# EasyEDA Pro project Chessboards.epro, board Diagonal (continued)
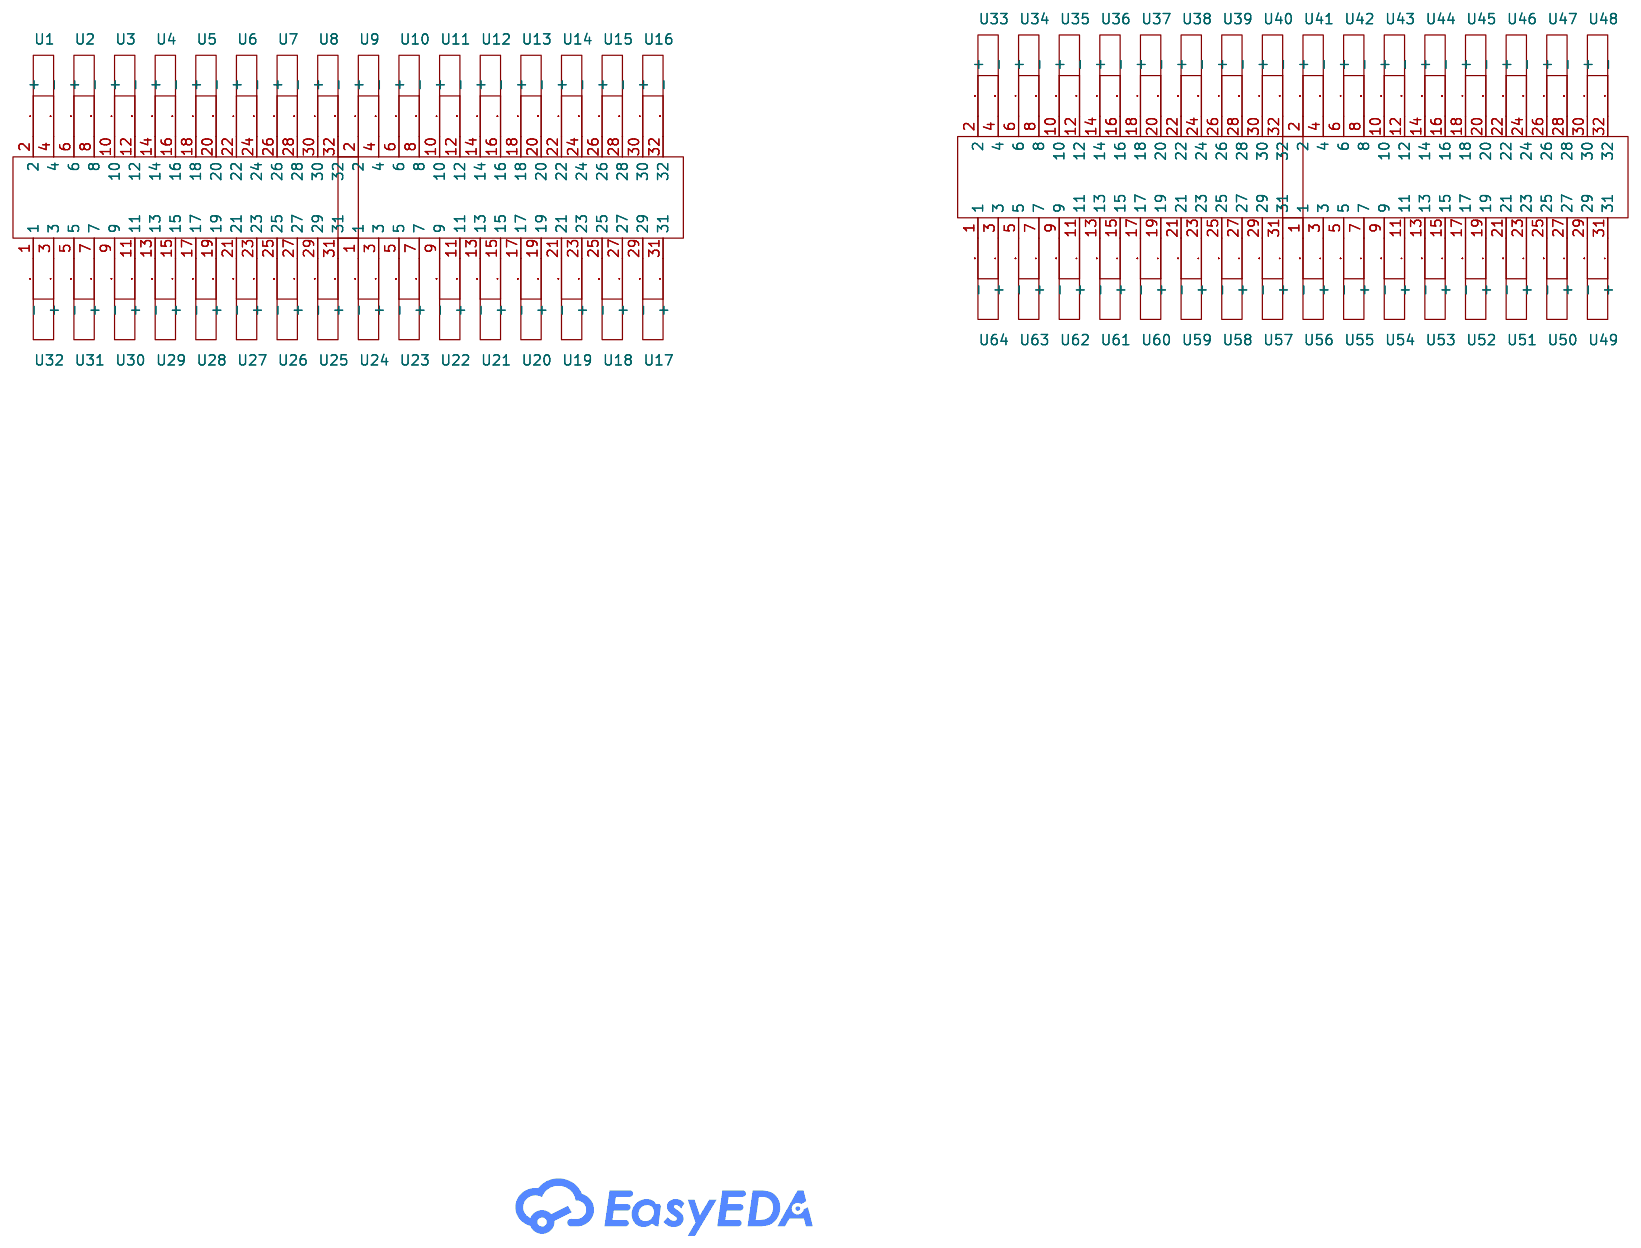
[diagram p0: schematic sheet]
## Routing (per net, layer and track width the routed paths; a pad name or vN(x,y) marks a point on that pad's centre or on a via; arc(x,y) is an arc through that point) (continued)
  Bottom Layer w0.254: 333.72,470.74 333.72,472.96 ; 333.72,470.74 333.72,470.71 334.58,469.85 ; 333.72,470.74 v2(334.58,469.87) ; 333.72,472.96 333.72,472.98 333.72,472.99 ; 333.72,472.96 333.72,472.96 ; 314.66,473.08 314.65,473.07 314.65,473.05 ; 327.28,478.03 327.28,478.06 327.6,478.37 ; 327.28,478.03 327.6,478.35 ; 327.28,478.03 327.28,476.69 ; 457.89,7.01 457.89,7.01 457.89,9.67 v2(458.4,10.18) ; v2(208.5,3.71) 208.5,1.43 ; 308.28,473.05 308.28,473.07 308.29,473.08 ; 308.28,473.05 308.29,473.05 ; 308.28,473.05 308.28,470.41 ; 158.22,472.96 158.22,472.96 158.22,470.72 v2(159.08,469.85) ; v2(94.92,476.35) 94.61,476.66 94.61,478.03 94.92,478.35 ; v2(392.1,476.35) 392.1,478.64 ; v2(391.33,10.22) 390.47,9.35 390.47,7.11 390.47,7.11 ; 230.25,7.11 230.25,7.11 230.25,9.35 v2(231.11,10.22) ; 255.16,478.35 254.84,478.03 254.84,476.66 v2(255.16,476.35) ; v2(226.78,476.35) 226.78,478.64 ; v2(74.19,476.35) 74.19,478.64 ; 412.2,469.89 411.29,470.81 411.29,472.96 ; 307.01,470.41 307.01,473.05 ; 307.01,470.41 307.01,470.39 307.52,469.88 ; 307.01,470.41 v2(307.52,469.9) ; 307.01,473.05 307.01,473.05 ; 307.01,473.05 307.01,473.07 307.01,473.08 ; 317.15,472.96 317.16,472.96 ; 317.15,472.96 317.15,472.98 317.16,472.99 ; 317.15,472.96 317.15,470.74 ; v2(223.16,10.19) 222.65,9.68 222.65,7.02 222.66,7.01 ; 165.87,472.99 165.82,472.99 165.77,472.93 165.77,470.81 166.7,469.87 ; 136.17,7.01 136.16,7.01 136.16,9.67 v2(136.68,10.18) ; 320.98,472.99 320.98,472.98 320.98,472.96 ; v2(394.02,469.88) 393.51,470.39 393.51,473.05 393.51,473.05 ; v2(391.47,469.88) 390.96,470.39 390.96,473.05 390.96,473.05 ; 301.78,476.35 301.78,478.66 ; v2(86.61,469.85) 85.63,470.84 85.63,472.96 85.63,472.96 85.75,472.96 ; v2(315.69,3.69) 315.38,3.38 315.38,2.01 315.69,1.69 ; v2(81.52,469.85) 80.65,470.71 80.65,472.96 80.66,472.96 ; 235.35,7.11 235.22,7.11 235.22,7.11 235.22,9.23 v2(236.21,10.22) ; v2(81.74,3.72) 81.42,3.4 81.42,2.03 81.74,1.72 ; 410,478.07 410,476.71 410.32,476.39 ; 410,478.07 409.96,478.03 409.96,476.66 v2(410.28,476.35) ; 410,478.07 410.28,478.35 ; 410,478.07 410,478.08 410.32,478.39 ; 334.89,472.96 334.89,472.98 334.89,472.99 334.99,472.99 ; 334.89,472.96 334.89,472.96 334.99,472.96 ; 334.89,472.96 334.89,470.84 ; v2(388.27,476.35) 388.27,478.64 ; 65.42,473.05 65.41,473.05 65.41,470.39 v2(65.93,469.88) ; 93.4,472.96 93.39,472.96 93.39,470.71 v2(94.26,469.85) ; 453.79,469.92 453.28,470.43 453.28,473.09 453.28,473.09 ; v2(400.09,476.35) 399.77,476.66 399.77,478.03 399.81,478.07 ; 407.46,478.07 407.41,478.03 407.41,476.66 v2(407.73,476.35) ; 407.46,478.07 407.46,478.08 407.77,478.39 ; 407.46,478.07 407.73,478.35 ; 407.46,478.07 407.46,476.71 407.77,476.39 ; 174.76,472.96 174.79,472.96 ; 174.76,472.96 174.74,472.96 ; 174.76,472.96 174.73,472.94 174.73,470.77 v2(175.65,469.85) ; v2(220.62,10.19) 220.11,9.68 220.11,7.02 220.11,7.01 ; 397.26,478.07 397.26,476.71 397.58,476.39 ; 397.26,478.07 397.54,478.35 ; 397.26,478.07 397.26,478.08 397.58,478.39 ; 397.26,478.07 397.22,478.03 397.22,476.66 v2(397.54,476.35) ; v2(240.7,3.72) 240.38,3.4 240.38,2.03 240.7,1.72 ; v2(231.78,3.72) 231.46,3.4 231.46,2.03 231.78,1.72 ; 402.68,478.39 402.36,478.08 402.36,478.07 ; 406.5,476.39 406.18,476.71 406.18,478.07 ; 248.78,478.35 248.47,478.03 248.47,476.66 v2(248.78,476.35) ; 145.53,473.05 145.53,473.05 145.53,470.39 v2(146.04,469.88) ; 408.73,478.07 408.73,476.71 409.05,476.39 ; 408.73,478.07 408.69,478.03 408.69,476.66 v2(409,476.35) ; 408.73,478.07 409,478.35 ; 408.73,478.07 408.73,478.08 409.05,478.39 ; v2(238.15,3.72) 237.83,3.4 237.83,2.03 238.15,1.72 ; v2(130.93,3.71) 130.93,1.42 ; 296.68,476.35 296.68,478.66 ; 412.62,473 412.61,473 412.61,470.76 413.48,469.89 ; v2(296.05,469.9) 295.54,470.41 ; 295.54,470.41 295.54,473.05 ; 295.54,470.41 295.54,470.39 296.05,469.88 ; v2(240.03,10.22) 239.17,9.35 239.17,7.11 239.17,7.11 ; 308.05,1.69 307.73,2.01 307.73,3.38 v2(308.05,3.69) ; v2(402.19,3.72) 401.87,3.4 401.87,2.03 402.19,1.72 ; v2(294.34,10.16) 293.83,9.65 293.83,6.99 293.83,6.99 ; v2(168.83,10.21) 167.97,9.35 167.97,7.1 167.97,7.1 ; 398.19,469.89 397.33,470.76 397.33,473 397.33,473 ; 323.45,470.81 323.45,470.79 324.39,469.85 ; 323.45,470.81 v2(324.39,469.87) ; 323.45,470.81 323.45,472.91 ; v2(82.79,469.85) 81.93,470.71 81.93,472.96 81.93,472.96 ; v2(405.35,10.22) 404.48,9.35 404.48,7.11 404.49,7.11 ; 408.38,469.89 407.52,470.76 407.52,473 407.52,473 ; v2(169.94,476.35) 169.62,476.67 169.62,478.03 169.94,478.35 ; 292.55,6.99 292.55,6.99 292.55,9.65 v2(293.06,10.16) ; 311.62,7.08 311.61,7.08 311.61,9.33 v2(312.48,10.19) ; 395.99,478.07 396.26,478.35 ; 395.99,478.07 395.99,478.08 396.31,478.39 ; 395.99,478.07 395.99,476.71 396.31,476.39 ; 395.99,478.07 395.95,478.03 395.95,476.66 v2(396.26,476.35) ; v2(247.51,476.35) 247.19,476.66 247.19,478.03 247.51,478.35 ; v2(163.74,10.21) 162.87,9.35 162.87,7.1 162.88,7.1 ; 142.98,473.05 142.98,473.05 142.98,470.39 v2(143.49,469.88) ; 394.72,478.07 394.99,478.35 ; 394.72,478.07 394.67,478.03 394.67,476.66 v2(394.99,476.35) ; 394.72,478.07 394.72,478.08 395.03,478.39 ; 394.72,478.07 394.72,476.71 395.03,476.39 ; 412.55,478.07 412.55,476.71 412.87,476.39 ; 412.55,478.07 412.51,478.03 412.51,476.66 v2(412.83,476.35) ; 412.55,478.07 412.83,478.35 ; 412.55,478.07 412.55,478.08 412.87,478.39 ; v2(382.11,10.19) 381.6,9.68 381.6,7.02 381.6,7.01 ; 87.28,478.35 86.96,478.03 86.96,476.66 v2(87.28,476.35) ; 167.14,472.96 167.14,472.96 167.14,470.72 v2(168,469.85) ; 177.33,472.99 177.21,472.99 177.21,472.98 177.21,470.84 178.17,469.87 ; v2(467.11,476.36) 467.11,478.64 ; 166.1,476.37 165.78,476.69 165.78,478.06 166.1,478.37 ; v2(388.18,3.72) 387.86,3.4 387.86,2.03 388.18,1.72 ; v2(151,10.21) 150.13,9.35 150.13,7.1 150.14,7.1 ; v2(153.54,10.21) 152.68,9.35 152.68,7.1 152.68,7.1 ; 411.29,472.96 411.28,472.96 411.25,472.93 411.25,470.76 v2(412.16,469.85) ; 411.29,472.96 411.29,472.98 411.32,473 411.34,473 ; 411.29,472.96 411.3,472.96 ; 317.41,476.35 317.09,476.66 317.09,476.69 ; 315.82,478.03 316.13,478.35 ; 315.82,478.03 315.82,476.69 ; 315.82,478.03 315.82,478.06 316.13,478.37 ; 297.33,469.88 296.82,470.39 296.82,470.41 ; 326.33,478.37 326.01,478.06 326.01,478.03 ; 374.95,469.92 374.44,470.43 374.44,473.09 374.44,473.1 ; v2(291.14,3.69) 291.14,1.4 ; v2(216.59,476.35) 216.59,478.64 ; 161,478.37 160.68,478.06 160.68,476.69 161,476.37 ; 318.37,476.69 318.37,476.66 318.68,476.35 ; 318.37,476.69 318.37,478.03 ; 318.37,476.69 v2(318.68,476.37) ; 310.83,473.05 310.83,473.07 310.83,473.08 ; 310.83,473.05 310.83,470.41 ; 310.83,473.05 310.83,473.05 ; v2(155.48,3.71) 155.17,3.4 155.17,2.03 155.48,1.71 ; 322.19,478.03 322.19,478.06 322.5,478.37 ; 322.19,478.03 322.5,478.35 ; 322.19,478.03 322.19,476.69 ; v2(72.3,469.88) 71.78,470.39 71.78,473.05 71.79,473.05 ; 380.81,473.1 380.81,473.09 380.81,470.43 381.32,469.92 ; v2(448.83,3.71) 448.83,1.42 ; v2(383.38,10.19) 382.87,9.68 382.87,7.02 382.88,7.01 ; 383.87,469.92 383.36,470.43 383.36,473.09 383.36,473.1 ; v2(255.76,469.85) 254.9,470.71 254.9,472.96 254.9,472.96 ; 157.78,7.1 157.75,7.1 157.7,7.15 157.7,9.27 v2(158.64,10.21) ; 380.77,473.05 380.77,473.05 380.77,470.39 v2(381.28,469.88) ; 159.05,7.1 159.05,7.1 159.05,9.35 v2(159.91,10.21) ; 142.54,7.01 142.53,7.01 142.53,9.67 v2(143.05,10.18) ; 252.61,478.35 252.29,478.03 252.29,476.66 v2(252.61,476.35) ; v2(73.43,10.22) 72.57,9.35 72.57,7.11 72.57,7.11 ; v2(300.71,10.16) 300.19,9.65 300.19,6.99 300.2,6.99 ; v2(242.42,476.35) 242.1,476.66 242.1,478.03 242.42,478.35 ; v2(244.3,469.85) 243.31,470.84 243.31,472.96 243.31,472.96 243.44,472.96 ; v2(305.8,10.16) 305.29,9.65 305.29,6.99 305.29,6.99 ; v2(62.73,476.35) 62.73,478.64 ; v2(86.84,3.72) 86.52,3.4 86.52,2.03 86.84,1.72 ; 385.42,7.01 385.42,7.02 385.42,9.68 v2(385.93,10.19) ; 82.76,7.11 82.76,7.11 82.76,9.35 v2(83.62,10.22) ; 404.91,478.07 405.18,478.35 ; 404.91,478.07 404.87,478.03 404.87,476.66 v2(405.18,476.35) ; 404.91,478.07 404.91,476.71 405.22,476.39 ; 404.91,478.07 404.91,478.08 405.22,478.39 ; 401.02,472.96 401.02,470.88 402.01,469.89 ; 401.02,472.96 400.98,472.96 400.98,472.96 400.98,470.84 v2(401.97,469.85) ; 401.02,472.96 401.02,473 401.03,473 401.15,473 ; 401.02,472.96 401.11,472.96 ; v2(77.25,10.22) 76.39,9.35 76.39,7.11 76.39,7.11 ; 331.42,476.35 331.11,476.66 331.11,476.69 ; 318.37,478.03 318.68,478.35 ; 318.37,478.03 318.37,478.06 318.68,478.37 ; v2(308.79,469.9) 308.28,470.41 ; 308.28,470.41 308.28,470.39 308.79,469.88 ; 313.38,473.08 313.38,473.07 313.38,473.05 ; 458.24,476.39 458.24,478.68 ; 165.84,472.96 165.79,472.91 165.79,470.79 v2(166.73,469.85) ; v2(161.02,476.35) 160.71,476.67 160.71,478.03 161.02,478.35 ; v2(223.61,469.88) 223.1,470.39 223.1,473.05 223.1,473.05 ; v2(313.89,469.9) 313.38,470.41 ; 313.38,470.41 313.38,470.39 313.89,469.88 ; 313.38,470.41 313.38,473.05 ; 154.42,473.07 154.42,470.41 154.93,469.9 ; 139.13,473.07 139.13,470.41 139.65,469.9 ; v2(387,476.35) 387,478.64 ; 376.23,469.92 375.71,470.43 375.71,473.09 375.72,473.1 ; 295.41,476.35 295.41,478.66 ; v2(414.71,469.85) 413.75,470.81 413.75,472.96 413.75,472.96 413.79,472.96 ; 403.95,476.39 403.63,476.71 403.63,478.07 ; v2(454.37,476.36) 454.37,478.64 ; 304.97,469.88 304.46,470.39 304.46,470.41 ; v2(399.64,3.72) 399.33,3.4 399.33,2.03 399.64,1.72 ; v2(56.56,10.19) 56.05,9.68 56.05,7.02 56.06,7.01 ; v2(464.57,476.36) 464.57,478.64 ; 332.39,472.93 332.42,472.96 332.45,472.96 ; 332.39,472.93 332.39,470.79 ; 332.39,472.93 332.39,472.96 332.42,472.99 332.45,472.99 ; 151.9,473.05 151.9,473.05 151.9,470.39 v2(152.41,469.88) ; 167.98,469.87 167.12,470.74 167.12,472.98 ; 77.92,1.72 77.6,2.03 77.6,3.4 v2(77.92,3.72) ; v2(468.39,476.36) 468.39,478.64 ; 177.59,478.35 177.27,478.03 177.27,476.67 v2(177.59,476.35) ; v2(453.1,476.36) 453.1,478.64 ; 456.34,469.92 455.83,470.43 455.83,473.09 455.83,473.09 ; 469.7,476.39 469.7,478.68 ; 301.91,470.41 301.91,470.39 302.42,469.88 ; 301.91,470.41 v2(302.42,469.9) ; 301.91,470.41 301.91,473.05 ; 298.09,473.05 298.09,473.07 298.09,473.08 ; 298.09,473.05 298.09,470.41 ; 298.09,473.05 298.09,473.05 ; 378.22,473.05 378.22,473.05 378.22,470.39 v2(378.73,469.88) ; 403.63,478.07 403.63,478.08 403.95,478.39 ; 403.63,478.07 403.91,478.35 ; 403.63,478.07 403.59,478.03 403.59,476.66 v2(403.91,476.35) ; v2(301.33,3.69) 301.33,1.4 ; 320.79,1.69 320.47,2.01 320.47,3.38 v2(320.79,3.69) ; 333.65,478.03 333.65,478.06 333.97,478.37 ; 333.65,478.03 333.97,478.35 ; 333.65,478.03 333.65,476.69 ; v2(462.02,476.36) 462.02,478.64 ; 86.01,478.35 85.69,478.03 85.69,476.66 v2(86.01,476.35) ; 299.37,470.41 299.37,473.05 ; 299.37,470.41 299.37,470.39 299.88,469.88 ; 299.37,470.41 v2(299.88,469.9) ; 299.37,473.05 299.37,473.05 ; 299.37,473.05 299.37,473.07 299.37,473.08 ; v2(257.04,469.85) 256.07,470.81 256.07,472.96 256.08,472.96 256.18,472.96 ; v2(463.94,469.88) 463.43,470.39 463.43,473.05 463.43,473.05 ; 162.02,472.99 162.02,472.98 162.02,470.74 162.88,469.87 ; v2(371.92,10.19) 371.41,9.68 371.41,7.02 371.41,7.01 ; 388.46,473.1 388.45,473.09 388.45,470.43 388.97,469.92 ; 460.88,473.05 460.88,473.05 460.88,470.39 v2(461.39,469.88) ; 468.53,473.05 468.52,473.05 468.52,470.39 v2(469.04,469.88) ; 389.69,473.05 389.69,473.05 389.69,470.39 v2(390.2,469.88) ; 155.23,7.1 155.23,7.1 155.23,9.35 v2(156.09,10.21) ; 176.9,469.87 176.03,470.74 176.03,472.98 ; 134.89,7.01 134.89,7.01 134.89,9.67 v2(135.4,10.18) ; 391,473.1 391,473.09 391,470.43 391.51,469.92 ; v2(458.84,469.88) 458.33,470.39 458.33,473.05 458.34,473.05 ; 83.46,478.35 83.14,478.03 83.14,476.66 v2(83.46,476.35) ; v2(311.2,10.19) 310.34,9.33 310.34,7.08 310.34,7.08 ; 410.03,472.96 410.02,472.96 410.02,470.71 v2(410.89,469.85) ; 387.69,469.92 387.18,470.43 387.18,473.09 387.18,473.1 ; v2(153.03,476.36) 153.03,478.64 ; v2(210.42,10.19) 209.91,9.68 209.91,7.02 209.92,7.01 ; 402.35,472.95 402.36,472.96 402.38,472.96 ; 402.35,472.95 402.35,470.83 403.28,469.89 ; 402.35,472.95 402.3,472.91 402.3,470.79 v2(403.24,469.85) ; 402.35,472.95 402.35,472.95 402.4,473 402.42,473 ; 318.43,470.74 318.43,472.96 ; 318.43,470.74 v2(319.29,469.87) ; 318.43,470.74 318.43,470.71 319.29,469.85 ; 318.43,472.96 318.43,472.98 318.43,472.99 ; 318.43,472.96 318.43,472.96 ; v2(385.1,469.88) 384.59,470.39 384.59,473.05 384.59,473.05 ; 464.75,473.09 464.74,473.09 464.74,470.43 465.26,469.92 ; v2(79.8,10.22) 78.86,9.28 78.86,7.16 78.92,7.11 78.94,7.11 ; 406.25,473 406.24,473 406.24,470.76 407.11,469.89 ; 319.7,472.96 319.71,472.96 ; 319.7,472.96 319.7,472.98 319.71,472.99 ; 319.7,472.96 319.7,470.74 ; v2(215.52,10.19) 215.01,9.68 215.01,7.02 215.01,7.01 ; v2(450.11,3.71) 450.11,1.42 ; 72.82,1.72 72.51,2.03 72.51,3.4 v2(72.82,3.72) ; 216.73,473.05 216.73,473.05 216.73,470.39 v2(217.24,469.88) ; v2(239.2,469.85) 238.34,470.71 238.34,472.96 238.34,472.96 ; v2(384.01,3.71) 384.01,1.43 ; v2(152.94,3.71) 152.62,3.4 152.62,2.03 152.94,1.71 ; 389.45,1.72 389.13,2.03 389.13,3.4 v2(389.45,3.72) ; v2(246.85,469.85) 245.98,470.71 245.98,472.96 245.99,472.96 ; 171.22,478.35 170.9,478.03 170.9,476.67 v2(171.22,476.35) ; 459.51,476.39 459.51,478.68 ; v2(250.06,476.35) 249.74,476.66 249.74,478.03 250.06,478.35 ; 331.11,476.69 331.11,478.03 ; 331.11,476.69 v2(331.42,476.37) ; 331.11,478.03 331.11,478.06 331.42,478.37 ; 331.11,478.03 331.42,478.35 ; v2(157.5,469.88) 156.99,470.39 156.99,473.05 157,473.05 ; v2(447.56,3.71) 447.56,1.42 ; v2(329.48,469.87) 328.62,470.74 ; 328.62,470.74 328.62,472.96 ; 328.62,470.74 328.62,470.71 329.48,469.85 ; 326.08,472.99 326.07,472.98 326.07,472.96 ; v2(380.63,476.35) 380.63,478.64 ; 296.38,6.99 296.37,6.99 296.37,9.65 v2(296.88,10.16) ; 324.74,476.69 324.74,476.66 325.05,476.35 ; 324.74,476.69 324.74,478.03 ; 324.74,476.69 v2(325.05,476.37) ; 317.15,470.74 317.15,470.71 318.02,469.85 ; 317.15,470.74 v2(318.02,469.87) ; 140.41,473.07 140.41,470.41 140.92,469.9 ; 170.53,469.87 169.66,470.74 169.66,472.98 ; 67.52,7.01 67.52,7.02 67.52,9.68 v2(68.03,10.19) ; 399.39,7.11 399.39,7.11 399.39,9.35 v2(400.25,10.22) ; v2(401.36,476.35) 401.04,476.66 401.04,478.03 401.09,478.07 ; 322.06,1.69 321.75,2.01 321.75,3.38 v2(322.06,3.69) ; 249.81,472.96 249.8,472.96 249.8,470.71 v2(250.67,469.85) ; 312.11,470.41 312.11,473.05 ; 312.11,470.41 v2(312.62,469.9) ; 312.11,470.41 312.11,470.39 312.62,469.88 ; 312.11,473.05 312.11,473.05 ; 312.11,473.05 312.11,473.07 312.11,473.08 ; 404.56,469.89 403.7,470.76 403.7,473 403.7,473 ; 324.8,470.74 324.8,472.96 ; 324.8,470.74 v2(325.66,469.87) ; 324.8,470.74 324.8,470.71 325.66,469.85 ; 324.8,472.96 324.8,472.98 324.8,472.99 ; 324.8,472.96 324.8,472.96 ; 323.45,472.91 323.45,472.93 323.5,472.99 323.53,472.99 ; 323.45,472.91 323.5,472.96 323.53,472.96 ; 395.57,7.11 395.57,7.11 395.57,9.35 v2(396.43,10.22) ; 89.83,478.35 89.51,478.03 89.51,476.66 v2(89.83,476.35) ; 73.06,473.05 73.06,473.05 73.06,470.39 v2(73.57,469.88) ; v2(163.57,476.35) 163.25,476.67 163.25,478.03 163.57,478.35 ; 299.23,478.66 v2(299.23,476.38) 299.23,476.35 ; 310.69,476.35 310.69,478.66 ; 295.54,473.05 295.54,473.07 295.55,473.08 ; 295.54,473.05 295.55,473.05 ; v2(237.93,469.85) 237.06,470.71 237.06,472.96 237.07,472.96 ; 323.08,7.08 323.08,7.08 323.08,9.33 v2(323.94,10.19) ; v2(445.01,3.71) 445.01,1.42 ; v2(245.57,469.85) 244.63,470.79 244.63,472.91 244.69,472.96 244.71,472.96 ; v2(143.67,3.71) 143.67,1.42 ; 159.31,1.71 158.99,2.03 158.99,3.4 v2(159.31,3.71) ; v2(450.76,10.18) 450.25,9.67 450.25,7.01 450.25,7.01 ; 163.55,476.37 163.23,476.69 163.23,478.06 163.55,478.37 ; 131.07,7.01 131.07,7.01 131.07,9.67 v2(131.58,10.18) ; v2(144.12,476.36) 144.12,478.64 ; v2(79.19,3.72) 78.88,3.4 78.88,2.03 79.19,1.72 ; v2(373.19,10.19) 372.68,9.68 372.68,7.02 372.68,7.01 ; v2(235.6,3.72) 235.28,3.4 235.28,2.03 235.6,1.72 ; 319.64,478.03 319.96,478.35 ; 319.64,478.03 319.64,476.69 ; 319.64,478.03 319.64,478.06 319.96,478.37 ; v2(142.4,3.71) 142.4,1.42 ; v2(460.95,10.18) 460.44,9.67 460.44,7.01 460.44,7.01 ; 229.47,473.05 229.47,473.05 229.47,470.39 v2(229.98,469.88) ; 221.83,473.05 221.82,473.05 221.82,470.39 v2(222.33,469.88) ; 332.39,470.79 v2(333.31,469.87) ; 332.39,470.79 332.39,470.76 333.31,469.85 ; v2(393.88,10.22) 392.89,9.23 392.89,7.11 392.9,7.11 393.02,7.11 ; v2(137.95,10.18) 137.44,9.67 137.44,7.01 137.44,7.01 ; v2(132.21,3.71) 132.21,1.42 ; v2(453.3,10.18) 452.79,9.67 452.79,7.01 452.8,7.01 ; 326.01,476.69 326.01,476.66 326.33,476.35 ; 326.01,476.69 v2(326.33,476.37) ; 326.01,476.69 326.01,478.03 ; 89.13,7.11 89.13,7.11 89.13,9.35 v2(89.99,10.22) ; 76.88,473.05 76.88,473.05 76.88,470.39 v2(77.39,469.88) ; 166.7,7.1 166.67,7.1 166.64,7.13 166.64,9.3 v2(167.56,10.21) ; 306.87,478.66 v2(306.87,476.38) 306.87,476.35 ; 366.31,7.01 366.31,7.02 366.31,9.68 v2(366.82,10.19) ; v2(133.48,3.71) 133.48,1.42 ; v2(374.91,469.88) 374.4,470.39 374.4,473.05 374.4,473.05 ; 320.54,7.08 320.53,7.08 320.53,9.33 v2(321.4,10.19) ; v2(220.41,476.35) 220.41,478.64 ; v2(242.58,10.22) 241.72,9.35 241.72,7.11 241.72,7.11 ; v2(243.25,3.72) 242.93,3.4 242.93,2.03 243.25,1.72 ; v2(59.11,10.19) 58.6,9.68 58.6,7.02 58.6,7.01 ; v2(72.16,10.22) 71.29,9.35 71.29,7.11 71.3,7.11 ; 389.2,7.11 389.2,7.11 389.2,9.35 v2(390.06,10.22) ; 382.05,473.05 382.04,473.05 382.04,470.39 v2(382.55,469.88) ; v2(239.42,3.72) 239.11,3.4 239.11,2.03 239.42,1.72 ; 391.75,7.11 391.74,7.11 391.74,9.35 v2(392.61,10.22) ; v2(383.83,469.88) 383.32,470.39 383.32,473.05 383.32,473.05 ; 471.12,473.09 471.11,473.09 471.11,470.43 471.63,469.92 ; v2(227.61,3.71) 227.61,1.43 ; 411.28,478.07 411.55,478.35 ; 411.28,478.07 411.24,478.03 411.24,476.66 v2(411.55,476.35) ; 411.28,478.07 411.28,476.71 411.59,476.39 ; 411.28,478.07 411.28,478.08 411.59,478.39 ; v2(145.39,476.36) 145.39,478.64 ; 296.82,470.41 v2(297.33,469.9) ; 296.82,470.41 296.82,473.05 ; v2(225.06,3.71) 225.06,1.43 ; v2(382.74,3.71) 382.74,1.43 ; 413.79,472.96 413.79,473 413.79,473 ; 413.79,472.96 413.79,470.86 414.75,469.89 ; 413.79,472.96 413.89,472.96 ; v2(459.03,3.71) 459.03,1.42 ; 322.25,472.96 322.13,472.96 322.12,472.96 ; v2(98.75,476.35) 98.43,476.66 98.43,478.03 98.75,478.35 ; 298.09,470.41 v2(298.6,469.9) ; 298.09,470.41 298.09,470.39 298.6,469.88 ; v2(209.15,10.19) 208.64,9.68 208.64,7.02 208.64,7.01 ; 408.75,472.96 408.75,472.96 408.75,470.71 v2(409.61,469.85) ; v2(313.14,3.69) 312.83,3.38 312.83,2.01 313.14,1.69 ; 401.09,478.07 401.09,476.71 401.4,476.39 ; 401.09,478.07 401.09,478.08 401.4,478.39 ; 401.09,478.07 401.36,478.35 ; 97.22,472.96 97.22,472.96 97.22,470.71 v2(98.08,469.85) ; 80.47,1.72 80.15,2.03 80.15,3.4 v2(80.47,3.72) ; v2(253.88,476.35) 253.56,476.66 253.56,478.03 253.88,478.35 ; v2(88.72,10.22) 87.81,9.3 87.81,7.13 87.83,7.11 87.86,7.11 ; 392.14,476.4 392.14,478.68 ; 327.28,476.69 327.28,476.66 327.6,476.35 ; 327.28,476.69 v2(327.6,476.37) ; v2(458.2,476.36) 458.2,478.64 ; 314.65,473.05 314.66,473.05 ; 314.65,473.05 314.65,470.41 ; 141.54,476.38 141.54,478.66 ; v2(374.47,10.19) 373.95,9.68 373.95,7.02 373.96,7.01 ; v2(140.94,469.88) 140.43,470.39 140.43,473.05 140.43,473.05 ; 153.96,7.1 153.95,7.1 153.95,9.35 v2(154.82,10.21) ; v2(221.06,469.88) 220.55,470.39 220.55,473.05 220.55,473.05 ; 379.54,473.1 379.54,473.09 379.54,470.43 380.05,469.92 ; 334.89,470.84 334.89,470.81 335.85,469.85 ; 334.89,470.84 v2(335.85,469.87) ; 315.44,7.08 315.42,7.08 315.36,7.13 315.36,9.25 v2(316.3,10.19) ; v2(172.49,476.35) 172.17,476.67 172.17,478.03 172.49,478.35 ; v2(320.12,10.19) 319.26,9.33 319.26,7.08 319.26,7.08 ; 301.47,6.99 301.47,6.99 301.47,9.65 v2(301.98,10.16) ; v2(462.22,10.18) 461.71,9.67 461.71,7.01 461.72,7.01 ; 168.22,1.71 167.91,2.03 167.91,3.4 v2(168.22,3.71) ; 334.93,478.03 335.25,478.35 ; 334.93,478.03 334.93,478.06 335.25,478.37 ; 334.93,478.03 334.93,476.69 ; 300.64,473.05 300.64,473.05 ; 300.64,473.05 300.64,470.41 ; 300.64,473.05 300.64,473.07 300.64,473.08 ; 315.88,472.99 315.88,472.98 315.88,472.96 ; v2(319.51,3.69) 319.2,3.38 319.2,2.01 319.51,1.69 ; v2(165.01,10.21) 164.15,9.35 164.15,7.1 164.15,7.1 ; 313.38,473.05 313.38,473.05 ; v2(296.24,3.69) 296.24,1.4 ; 300.64,470.41 300.64,470.39 301.15,469.88 ; 300.64,470.41 v2(301.15,469.9) ; 156.51,7.1 156.38,7.1 156.38,7.1 156.38,9.22 v2(157.37,10.21) ; v2(295.61,10.16) 295.1,9.65 295.1,6.99 295.1,6.99 ; 329.89,470.74 329.89,472.96 ; 329.89,470.74 v2(330.76,469.87) ; 329.89,470.74 329.89,470.71 330.76,469.85 ; 329.89,472.96 329.89,472.98 329.9,472.99 ; 329.89,472.96 329.9,472.96 ; 303.19,470.41 303.19,470.39 303.7,469.88 ; 303.19,470.41 v2(303.7,469.9) ; 303.19,470.41 303.19,473.05 ; v2(323.11,469.87) 322.12,470.86 ; 322.12,470.86 322.12,472.96 ; 322.12,470.86 322.12,470.84 323.11,469.85 ; v2(457.75,3.71) 457.75,1.42 ; v2(328.21,469.87) 327.35,470.74 ; 327.35,470.74 327.35,470.71 328.21,469.85 ; 327.35,470.74 327.35,472.96 ; v2(76.64,3.72) 76.33,3.4 76.33,2.03 76.64,1.72 ; 398.54,478.07 398.5,478.03 398.5,476.66 v2(398.81,476.35) ; 398.54,478.07 398.54,476.71 398.85,476.39 ; 398.54,478.07 398.81,478.35 ; 398.54,478.07 398.54,478.08 398.85,478.39 ; 317.41,478.37 317.09,478.06 317.09,478.03 ; 67.97,473.05 67.96,473.05 67.96,470.39 v2(68.47,469.88) ; 92.12,472.96 92.12,472.96 92.12,470.71 v2(92.98,469.85) ; 319.64,476.69 v2(319.96,476.37) ; 319.64,476.69 319.64,476.66 319.96,476.35 ; 385.77,476.4 385.77,478.68 ; 387.14,473.05 387.14,473.05 387.14,470.39 v2(387.65,469.88) ; v2(392.75,469.88) 392.23,470.39 392.23,473.05 392.24,473.05 ; 77.67,7.11 77.54,7.11 77.54,7.11 77.54,9.23 v2(78.53,10.22) ; 324.61,1.69 324.29,2.01 324.29,3.38 v2(324.61,3.69) ; v2(467.76,469.88) 467.25,470.39 467.25,473.05 467.25,473.05 ; v2(300.06,3.69) 300.06,1.4 ; 374.3,476.4 374.3,478.68 ; 146.64,476.38 146.64,478.66 ; 229.23,1.72 228.92,2.03 228.92,3.4 v2(229.23,3.72) ; v2(171.82,469.85) 170.96,470.72 170.96,472.96 170.96,472.96 ; 303.19,473.05 303.19,473.07 303.19,473.08 ; 303.19,473.05 303.19,473.05 ; v2(144.76,469.88) 144.25,470.39 144.25,473.05 144.26,473.05 ; 332.38,476.69 332.38,478.06 332.7,478.37 ; 332.38,476.69 v2(332.7,476.37) ; 332.38,476.69 332.38,476.66 332.7,476.35 ; 304.46,470.41 304.46,473.05 ; 304.46,470.41 v2(304.97,469.9) ; 304.46,473.05 304.46,473.07 304.46,473.08 ; 304.46,473.05 304.46,473.05 ; v2(69.1,476.35) 69.1,478.64 ; 322.12,472.96 322.12,472.98 322.13,472.99 322.25,472.99 ; v2(224.88,469.88) 224.37,470.39 224.37,473.05 224.37,473.05 ; v2(369.37,10.19) 368.86,9.68 368.86,7.02 368.86,7.01 ; 311.97,476.35 311.97,478.66 ; 326.07,472.96 326.07,470.74 ; 326.07,472.96 326.08,472.96 ; 405.76,7.11 405.66,7.11 405.66,7.11 405.66,9.25 v2(406.62,10.22) ; v2(309.93,10.19) 309.07,9.33 309.07,7.08 309.07,7.08 ; v2(139.67,469.88) 139.16,470.39 139.16,473.05 139.16,473.05 ; v2(397.7,10.22) 396.84,9.35 396.84,7.11 396.84,7.11 ; v2(297.51,3.69) 297.51,1.4 ; 393.27,1.72 392.96,2.03 392.96,3.4 v2(393.27,3.72) ; 129.8,7.01 129.79,7.01 129.79,9.67 v2(130.31,10.18) ; 378.12,476.4 378.12,478.68 ; 327.16,1.69 326.84,2.01 326.84,3.38 v2(327.16,3.69) ; 96.2,478.35 95.88,478.03 95.88,476.66 v2(96.2,476.35) ; v2(154.96,469.88) 154.44,470.39 154.44,473.05 154.45,473.05 ; 406.21,472.96 406.2,472.96 406.2,470.71 v2(407.07,469.85) ; 454.07,7.01 454.07,7.01 454.07,9.67 v2(454.58,10.18) ; v2(71.02,469.88) 70.51,470.39 70.51,473.05 70.51,473.05 ; v2(155.58,476.36) 155.58,478.64 ; 80.21,7.11 80.21,7.11 80.21,9.35 v2(81.08,10.22) ; v2(80.91,476.35) 80.59,476.66 80.59,478.03 80.91,478.35 ; 173.74,478.37 173.42,478.06 173.42,476.69 173.74,476.37 ; 147.29,469.9 146.78,470.41 146.78,473.07 ; 63.7,7.01 63.7,7.02 63.7,9.68 v2(64.21,10.19) ; 150.6,473.07 150.6,470.41 151.11,469.9 ; 242.99,7.11 242.99,7.11 242.99,9.35 v2(243.85,10.22) ; 226.48,7.01 226.48,7.02 226.48,9.68 v2(226.99,10.19) ; 233.29,473.05 233.29,473.05 233.29,470.39 v2(233.8,469.88) ; v2(145.59,10.18) 145.08,9.67 145.08,7.01 145.09,7.01 ; v2(146.22,3.71) 146.22,1.42 ; 160.33,7.1 160.32,7.1 160.32,9.35 v2(161.19,10.21) ; 87.03,472.96 87,472.96 86.95,472.91 86.95,470.79 v2(87.89,469.85) ; v2(231.25,469.88) 230.74,470.39 230.74,473.05 230.74,473.05 ; 301.91,473.05 301.92,473.05 ; 301.91,473.05 301.91,473.07 301.92,473.08 ; v2(175.04,476.35) 174.72,476.67 174.72,478.03 175.04,478.35 ; 326.07,470.74 v2(326.94,469.87) ; 326.07,470.74 326.07,470.71 326.94,469.85 ; v2(134.75,3.71) 134.75,1.42 ; v2(222.52,3.71) 222.52,1.43 ; 390.24,469.92 389.73,470.43 389.73,473.09 389.73,473.1 ; v2(256.43,476.35) 256.11,476.66 256.11,478.03 256.43,478.35 ; v2(217.86,476.35) 217.86,478.64 ; 242.16,472.96 242.16,472.96 242.16,470.71 v2(243.02,469.85) ; v2(61.66,10.19) 61.15,9.68 61.15,7.02 61.15,7.01 ; v2(226.16,469.88) 225.64,470.39 225.64,473.05 225.65,473.05 ; v2(463.5,10.18) 462.99,9.67 462.99,7.01 462.99,7.01 ; v2(231.88,476.35) 231.88,478.64 ; v2(150.39,3.71) 150.07,3.4 150.07,2.03 150.39,1.71 ; v2(460.74,476.36) 460.74,478.64 ; 305.6,476.35 v2(305.6,476.38) 305.6,478.66 ; v2(142.84,476.36) 142.84,478.64 ; v2(219.97,3.71) 219.97,1.43 ; v2(372.54,3.71) 372.54,1.43 ; 331.17,472.99 331.17,472.98 331.17,472.96 ; 451.52,7.01 451.52,7.01 451.52,9.67 v2(452.03,10.18) ; 472.35,473.05 472.35,473.05 472.35,470.39 v2(472.86,469.88) ; v2(245.13,10.22) 244.26,9.35 244.26,7.11 244.27,7.11 ; 226.92,473.05 226.92,473.05 226.92,470.39 v2(227.43,469.88) ; v2(376.81,476.35) 376.81,478.64 ; v2(62.1,469.88) 61.59,470.39 61.59,473.05 61.6,473.05 ; 376.51,7.01 376.5,7.02 376.5,9.68 v2(377.01,10.19) ; v2(395.6,469.85) 394.74,470.71 394.74,472.96 394.74,472.96 ; 380.67,476.4 380.67,478.68 ; 323.46,478.03 323.78,478.35 ; 323.46,478.03 323.46,476.69 ; 323.46,478.03 323.46,478.06 323.78,478.37 ; 164.59,472.96 164.47,472.96 164.46,472.96 164.46,470.84 v2(165.45,469.85) ; 153.01,476.38 153.01,478.66 ; 399.84,472.96 399.83,472.96 399.83,470.71 v2(400.7,469.85) ; 309.56,470.41 309.56,473.05 ; 309.56,470.41 309.56,470.39 310.07,469.88 ; 309.56,470.41 v2(310.07,469.9) ; 309.56,473.05 309.56,473.05 ; 309.56,473.05 309.56,473.07 309.56,473.08 ; v2(162.46,10.21) 161.6,9.35 161.6,7.1 161.6,7.1 ; v2(64,476.35) 64,478.64 ; v2(461.57,3.71) 461.57,1.42 ; 405.83,469.89 404.97,470.76 404.97,473 404.97,473 ; 310.6,1.69 310.28,2.01 310.28,3.38 v2(310.6,3.69) ; v2(87.45,10.22) 86.58,9.35 86.58,7.11 86.58,7.11 ; 305.74,473.05 305.74,473.07 305.74,473.08 ; 305.74,473.05 305.74,473.05 ; 305.74,473.05 305.74,470.41 ; 95.95,472.96 95.92,472.96 95.89,472.93 95.89,470.76 v2(96.81,469.85) ; v2(313.75,10.19) 312.89,9.33 312.89,7.08 312.89,7.08 ; 453.24,473.05 453.24,473.05 453.24,470.39 v2(453.75,469.88) ; 148.91,7.01 148.9,7.01 148.9,9.67 v2(149.42,10.18) ; 84.48,472.96 84.48,472.96 84.48,470.71 v2(85.34,469.85) ; 248.09,7.11 247.99,7.11 247.99,7.11 247.99,9.25 v2(248.95,10.22) ; 376.95,473.05 376.95,473.05 376.95,470.39 v2(377.46,469.88) ; v2(392,3.72) 391.68,3.4 391.68,2.03 392,1.72 ; 309.32,1.69 309,2.01 309,3.38 v2(309.32,3.69) ; v2(60.83,469.88) 60.32,470.39 60.32,473.05 60.32,473.05 ; v2(71.55,3.72) 71.23,3.4 71.23,2.03 71.55,1.72 ; 381.95,476.4 381.95,478.68 ; v2(328.88,476.37) 328.56,476.69 ; 328.56,476.69 328.56,478.03 ; 328.56,476.69 328.56,476.66 328.88,476.35 ; 158.45,478.37 158.14,478.06 158.14,476.69 158.45,476.37 ; 402.68,476.39 402.36,476.71 402.36,478.07 ; 463.98,469.92 463.47,470.43 463.47,473.09 463.47,473.09 ; v2(373.82,3.71) 373.82,1.43 ; v2(451.38,3.71) 451.38,1.42 ; 168.42,472.96 168.41,472.96 168.41,470.72 v2(169.28,469.85) ; 455.79,473.05 455.78,473.05 455.78,470.39 v2(456.3,469.88) ; v2(142.22,469.88) 141.7,470.39 141.7,473.05 141.71,473.05 ; 316.74,469.85 315.88,470.71 315.88,470.74 ; 462.16,473.05 462.15,473.05 462.15,470.39 v2(462.67,469.88) ; v2(384.45,476.35) 384.45,478.64 ; 142.82,476.38 142.82,478.66 ; v2(170.11,10.21) 169.14,9.25 169.14,7.1 169.15,7.1 169.25,7.1 ; 252.36,472.96 252.35,472.96 252.35,470.71 v2(253.22,469.85) ; 153.17,473.05 153.17,473.05 153.17,470.39 v2(153.68,469.88) ; 388.32,476.4 388.32,478.68 ; v2(293.69,3.69) 293.69,1.4 ; v2(54.02,10.19) 53.5,9.68 53.5,7.02 53.51,7.01 ; v2(251.33,476.35) 251.02,476.66 251.02,478.03 251.33,478.35 ; 167.37,478.37 167.05,478.06 167.05,476.69 167.37,476.37 ; 225.2,7.01 225.2,7.02 225.2,9.68 v2(225.71,10.19) ; v2(212.97,10.19) 212.46,9.68 212.46,7.02 212.46,7.01 ; v2(321.84,469.87) 320.98,470.74 ; 320.98,470.74 320.98,470.71 321.84,469.85 ; 320.98,470.74 320.98,472.96 ; v2(398.15,469.85) 397.28,470.71 397.28,472.96 397.29,472.96 ; 247.07,1.72 246.75,2.03 246.75,3.4 v2(247.07,3.72) ; 397.1,1.72 396.78,2.03 396.78,3.4 v2(397.1,3.72) ; 138.72,7.01 138.71,7.01 138.71,9.67 v2(139.22,10.18) ; 162.05,472.96 162.04,472.96 162.04,470.72 v2(162.91,469.85) ; v2(147.31,469.88) 146.8,470.39 146.8,473.05 146.8,473.05 ; 321.23,478.37 320.92,478.06 320.92,478.03 ; 328.56,478.03 328.88,478.35 ; 328.56,478.03 328.56,478.06 328.88,478.37 ; 145.5,473.07 145.5,470.41 146.02,469.9 ; 142.96,473.07 142.96,470.41 143.47,469.9 ; v2(311.34,469.9) 310.83,470.41 ; 310.83,470.41 310.83,470.39 311.34,469.88 ; 414.14,476.39 413.83,476.71 413.83,478.07 ; 467.3,473.09 467.29,473.09 467.29,470.43 467.8,469.92 ; 83.01,1.72 82.7,2.03 82.7,3.4 v2(83.01,3.72) ; v2(393.37,476.35) 393.37,478.64 ; 287.46,6.99 287.46,6.99 287.46,9.65 v2(287.97,10.16) ; 291.28,6.99 291.28,6.99 291.28,9.65 v2(291.79,10.16) ; 464.71,473.05 464.7,473.05 464.7,470.39 v2(465.21,469.88) ; v2(160.36,469.85) 159.49,470.72 159.49,472.96 159.5,472.96 ; 68.8,7.01 68.79,7.02 68.79,9.68 v2(69.3,10.19) ; 309.42,478.66 v2(309.42,476.38) 309.42,476.35 ; v2(211.7,10.19) 211.19,9.68 211.19,7.02 211.19,7.01 ; v2(75.37,3.72) 75.05,3.4 75.05,2.03 75.37,1.72 ; 59.88,7.01 59.87,7.02 59.87,9.68 v2(60.39,10.19) ; 459.17,7.01 459.16,7.01 459.16,9.67 v2(459.67,10.18) ; v2(55.29,10.19) 54.78,9.68 54.78,7.02 54.78,7.01 ; 455.06,469.92 454.55,470.43 454.55,473.09 454.56,473.09 ; v2(398.98,10.22) 398.11,9.35 398.11,7.11 398.12,7.11 ; v2(86.17,10.22) 85.31,9.35 85.31,7.11 85.31,7.11 ; v2(460.3,3.71) 460.3,1.42 ; v2(68.65,3.71) 68.65,1.43 ; v2(456.92,476.36) 456.92,478.64 ; 172.47,476.37 172.15,476.69 172.15,478.06 172.47,478.37 ; v2(370,3.71) 370,1.43 ; 161.85,1.71 161.54,2.03 161.54,3.4 v2(161.85,3.71) ; 379.05,7.01 379.05,7.02 379.05,9.68 v2(379.56,10.19) ; v2(466.49,469.88) 465.98,470.39 465.98,473.05 465.98,473.05 ; 407.48,472.96 407.48,472.96 407.48,470.71 v2(408.34,469.85) ; 296.82,473.05 296.82,473.05 ; 296.82,473.05 296.82,473.07 296.82,473.08 ; 171.19,478.37 170.88,478.06 170.88,476.69 171.19,476.37 ; 382.6,469.92 382.08,470.43 382.08,473.09 382.09,473.1 ; 213.74,7.01 213.74,7.02 213.74,9.68 v2(214.25,10.19) ; v2(159.75,476.35) 159.43,476.67 159.43,478.03 159.75,478.35 ; 455.35,7.01 455.34,7.01 455.34,9.67 v2(455.85,10.18) ; 460.93,473.09 460.92,473.09 460.92,470.43 461.43,469.92 ; v2(154.31,476.36) 154.31,478.64 ; 173.51,472.96 173.51,472.96 173.51,470.72 v2(174.37,469.85) ; 467.15,476.39 467.15,478.68 ; 412.58,472.96 412.57,472.96 412.57,470.71 v2(413.44,469.85) ; v2(91.1,476.35) 90.79,476.66 90.79,478.03 91.1,478.35 ; 164.4,1.71 164.08,2.03 164.08,3.4 v2(164.4,3.71) ; v2(166.95,3.71) 166.63,3.4 166.63,2.03 166.95,1.71 ; 132.35,7.01 132.34,7.01 132.34,9.67 v2(132.85,10.18) ; 253.63,472.96 253.6,472.96 253.58,472.93 253.58,470.76 v2(254.49,469.85) ; 173.49,472.98 173.49,470.74 174.35,469.87 ; 177.56,478.37 177.25,478.06 177.25,476.69 177.56,476.37 ; 384.63,473.1 384.63,473.09 384.63,470.43 385.14,469.92 ; 237.32,478.35 237,478.03 237,476.66 v2(237.32,476.35) ; v2(228.06,476.35) 228.06,478.64 ; 324.74,478.03 325.05,478.35 ; 324.74,478.03 324.74,478.06 325.05,478.37 ; v2(402.63,476.35) 402.32,476.66 402.32,478.03 402.36,478.07 ; 384.49,476.4 384.49,478.68 ; 464.26,7.01 464.26,7.01 464.26,9.67 v2(464.77,10.18) ; v2(64.65,469.88) 64.14,470.39 64.14,473.05 64.14,473.05 ; v2(251.94,469.85) 251.08,470.71 251.08,472.96 251.08,472.96 ; 315.88,472.96 315.88,472.96 ; 315.88,472.96 315.88,470.74 ; v2(449.48,10.18) 448.97,9.67 448.97,7.01 448.98,7.01 ; v2(50.82,3.71) 50.82,1.43 ; 321.81,7.08 321.81,7.08 321.81,9.33 v2(322.67,10.19) ; 142.19,469.9 141.68,470.41 141.68,473.07 ; v2(90.44,469.85) 89.57,470.71 89.57,472.96 89.58,472.96 ; v2(402.8,10.22) 401.94,9.35 401.94,7.11 401.94,7.11 ; v2(323.34,3.69) 323.02,3.38 323.02,2.01 323.34,1.69 ; 328.62,472.96 328.62,472.96 ; 328.62,472.96 328.62,472.98 328.62,472.99 ; v2(99.35,469.85) 98.39,470.81 98.39,472.96 98.39,472.96 98.49,472.96 ; 234.08,7.11 234.07,7.11 234.07,9.35 v2(234.94,10.22) ; 386.9,1.72 386.59,2.03 386.59,3.4 v2(386.9,3.72) ; 389.59,476.4 389.59,478.68 ; 52.23,7.01 52.23,7.02 52.23,9.68 v2(52.74,10.19) ; 332.38,478.03 332.7,478.35 ; 237.9,7.11 237.89,7.11 237.89,9.35 v2(238.76,10.22) ; 326.01,478.03 326.33,478.35 ; 457.1,473.09 457.1,473.09 457.1,470.43 457.61,469.92 ; 175.01,478.37 174.7,478.06 174.7,476.69 175.01,476.37 ; 232.02,473.05 232.01,473.05 232.01,470.39 v2(232.53,469.88) ; 219.28,473.05 219.27,473.05 219.27,470.39 v2(219.79,469.88) ; v2(74.71,10.22) 73.84,9.35 73.84,7.11 73.84,7.11 ; v2(311.87,3.69) 311.55,3.38 311.55,2.01 311.87,1.69 ; v2(333.97,476.37) 333.65,476.69 ; 333.65,476.69 333.65,476.66 333.97,476.35 ; v2(141.12,3.71) 141.12,1.42 ; 313.24,478.66 v2(313.24,476.38) 313.24,476.35 ; 165.42,7.1 165.42,7.1 165.42,9.35 v2(166.28,10.21) ; v2(64.83,3.71) 64.83,1.43 ; v2(380.84,10.19) 380.32,9.68 380.32,7.02 380.33,7.01 ; v2(299.43,10.16) 298.92,9.65 298.92,6.99 298.92,6.99 ; v2(82.35,10.22) 81.49,9.35 81.49,7.11 81.49,7.11 ; 144.23,473.07 144.23,470.41 144.74,469.9 ; 167.39,478.35 167.08,478.03 167.08,476.67 v2(167.39,476.35) ; v2(368.72,3.71) 368.72,1.43 ; v2(378.29,10.19) 377.78,9.68 377.78,7.02 377.78,7.01 ; 148.05,473.07 148.05,470.41 148.56,469.9 ; v2(66.55,476.35) 66.55,478.64 ; v2(233.15,476.35) 233.15,478.64 ; v2(459.47,476.36) 459.47,478.64 ; 320.92,478.03 321.23,478.35 ; 320.92,478.03 320.92,476.69 ; 69.24,473.05 69.24,473.05 69.24,470.39 v2(69.75,469.88) ; v2(247.68,10.22) 246.81,9.35 246.81,7.11 246.82,7.11 ; v2(381.46,3.71) 381.46,1.43 ; v2(398.37,3.72) 398.05,3.4 398.05,2.03 398.37,1.72 ; 75.61,473.05 75.61,473.05 75.61,470.39 v2(76.12,469.88) ; 160.77,472.96 160.77,472.96 160.77,470.72 v2(161.63,469.85) ; 370.14,7.01 370.13,7.02 370.13,9.68 v2(370.64,10.19) ; v2(230.51,3.72) 230.19,3.4 230.19,2.03 230.51,1.72 ; 244.96,478.35 244.65,478.03 244.65,476.66 v2(244.96,476.35) ; v2(380.19,3.71) 380.19,1.43 ; v2(455.02,469.88) 454.51,470.39 454.51,473.05 454.51,473.05 ; 217.56,7.01 217.56,7.02 217.56,9.68 v2(218.07,10.19) ; 402.36,478.07 402.63,478.35 ; 146.36,7.01 146.36,7.01 146.36,9.67 v2(146.87,10.18) ; 406.01,1.72 405.7,2.03 405.7,3.4 v2(406.01,3.72) ; 322.19,476.69 322.19,476.66 322.5,476.35 ; 322.19,476.69 v2(322.5,476.37) ; 325.63,7.08 325.63,7.08 325.63,9.33 v2(326.49,10.19) ; 469.8,473.05 469.8,473.05 469.8,470.39 v2(470.31,469.88) ; 241.97,1.72 241.66,2.03 241.66,3.4 v2(241.97,3.72) ; 79.64,478.35 79.32,478.03 79.32,476.66 v2(79.64,476.35) ; 388.42,473.05 388.41,473.05 388.41,470.39 v2(388.92,469.88) ; v2(380.01,469.88) 379.49,470.39 379.49,473.05 379.5,473.05 ; v2(91.27,10.22) 90.3,9.25 90.3,7.11 90.31,7.11 90.41,7.11 ; v2(67.38,3.71) 67.38,1.43 ; 399.88,473 399.87,473 399.87,470.76 400.74,469.89 ; v2(315.16,469.9) 314.65,470.41 ; 314.65,470.41 314.65,470.39 315.16,469.88 ; 403.66,472.96 403.65,472.96 403.65,470.71 v2(404.52,469.85) ; 92.38,478.35 92.06,478.03 92.06,476.66 v2(92.38,476.35) ; 75.12,7.11 75.12,7.11 75.12,9.35 v2(75.98,10.22) ; 133.62,7.01 133.62,7.01 133.62,9.67 v2(134.13,10.18) ; 331.17,470.74 331.17,470.71 332.03,469.85 ; 331.17,470.74 331.17,472.96 ; 331.17,470.74 v2(332.03,469.87) ; 406.18,478.07 406.46,478.35 ; 406.18,478.07 406.14,478.03 406.14,476.66 v2(406.46,476.35) ; 406.18,478.07 406.18,478.08 406.5,478.39 ; v2(248.12,469.85) 247.26,470.71 247.26,472.96 247.26,472.96 ; v2(60.18,476.35) 60.18,478.64 ; v2(69.93,3.71) 69.93,1.43 ; v2(376.18,469.88) 375.67,470.39 375.67,473.05 375.68,473.05 ; v2(405.79,469.85) 404.93,470.71 404.93,472.96 404.93,472.96 ; v2(58.46,3.71) 58.46,1.43 ; v2(228.26,10.19) 227.75,9.68 227.75,7.02 227.75,7.01 ; 141.26,7.01 141.26,7.01 141.26,9.67 v2(141.77,10.18) ; v2(95.53,469.85) 94.67,470.71 94.67,472.96 94.67,472.96 ; 66.25,7.01 66.24,7.02 66.24,9.68 v2(66.76,10.19) ; 158.2,472.99 158.2,472.98 158.2,470.74 159.06,469.87 ; 326.91,7.08 326.81,7.08 326.8,7.08 326.8,9.23 v2(327.77,10.19) ; 384.15,7.01 384.15,7.02 384.15,9.68 v2(384.66,10.19) ; v2(216.15,3.71) 216.15,1.43 ; 314.42,1.69 314.1,2.01 314.1,3.38 v2(314.42,3.69) ; 169.92,476.37 169.6,476.69 169.6,478.06 169.92,478.37 ; v2(154.21,3.71) 153.89,3.4 153.89,2.03 154.21,1.71 ; 472.9,469.92 472.39,470.43 472.39,473.09 472.39,473.09 ; 152.38,469.9 151.87,470.41 151.87,473.07 ; v2(306.25,469.9) 305.74,470.41 ; 305.74,470.41 305.74,470.39 306.25,469.88 ; 396.91,469.89 396.05,470.76 396.05,473 396.05,473 ; 413.83,478.07 413.83,478.08 414.14,478.39 ; 413.83,478.07 413.78,478.03 413.78,476.66 v2(414.1,476.35) ; 413.83,478.07 414.1,478.35 ; v2(164.18,469.85) 163.32,470.72 163.32,472.96 163.32,472.96 ; 84.29,1.72 83.97,2.03 83.97,3.4 v2(84.29,3.72) ; v2(89.16,469.85) 88.3,470.71 88.3,472.96 88.3,472.96 ; 50.96,7.01 50.96,7.02 50.96,9.68 v2(51.47,10.19) ; 140.27,476.38 140.27,478.66 ; v2(62.93,10.19) 62.42,9.68 62.42,7.02 62.43,7.01 ; 246.24,478.35 245.92,478.03 245.92,476.66 v2(246.24,476.35) ; 330.15,476.35 329.83,476.66 329.83,476.69 ; v2(233.66,10.22) 232.8,9.35 232.8,7.11 232.8,7.11 ; 145.37,476.38 145.37,478.66 ; 457.06,473.05 457.06,473.05 457.06,470.39 v2(457.57,469.88) ; v2(315.03,10.19) 314.04,9.2 314.04,7.08 314.04,7.08 314.17,7.08 ; 97.47,478.35 97.16,478.03 97.16,476.66 v2(97.47,476.35) ; 392.79,469.92 392.28,470.43 392.28,473.09 392.28,473.1 ; 83.21,472.96 83.2,472.96 83.2,470.71 v2(84.07,469.85) ; 399.81,478.07 400.09,478.35 ; 399.81,478.07 399.81,476.71 400.13,476.39 ; 399.81,478.07 399.81,478.08 400.13,478.39 ; v2(235.07,469.88) 234.56,470.39 234.56,473.05 234.57,473.05 ; v2(63.56,3.71) 63.56,1.43 ; 239.62,472.96 239.61,472.96 239.61,470.71 v2(240.48,469.85) ; v2(386.38,469.88) 385.86,470.39 385.86,473.05 385.87,473.05 ; v2(78.67,469.88) 78.15,470.39 78.15,473.05 78.16,473.05 ; v2(223.79,3.71) 223.79,1.43 ; v2(176.92,469.85) 176.06,470.72 176.06,472.96 176.06,472.96 ; 462.2,473.09 462.2,473.09 462.2,470.43 462.71,469.92 ; 164.84,478.35 164.53,478.03 164.53,476.67 v2(164.84,476.35) ; 306.57,6.99 306.56,6.99 306.56,9.65 v2(307.08,10.16) ; 318.24,1.69 317.92,2.01 317.92,3.38 v2(318.24,3.69) ; v2(303.25,10.16) 302.74,9.65 302.74,6.99 302.75,6.99 ; 144.09,476.38 144.09,478.66 ; 157.48,469.9 156.97,470.41 156.97,473.07 ; v2(228.7,469.88) 228.19,470.39 228.19,473.05 228.2,473.05 ; v2(374.26,476.35) 374.26,478.64 ; 377.5,469.92 376.99,470.43 376.99,473.09 376.99,473.1 ; 409.65,469.89 408.79,470.76 408.79,473 408.79,473 ; 394.29,7.11 394.27,7.11 394.22,7.16 394.22,9.28 v2(395.16,10.22) ; 456.62,7.01 456.62,7.01 456.62,9.67 v2(457.13,10.18) ; v2(375.09,3.71) 375.09,1.43 ; 164.82,476.37 164.51,476.69 164.51,478.06 164.82,478.37 ; 468.43,476.39 468.43,478.68 ; v2(160.58,3.71) 160.26,3.4 160.26,2.03 160.58,1.71 ; v2(399.42,469.85) 398.56,470.71 398.56,472.96 398.56,472.96 ; 70.07,7.01 70.07,7.02 70.07,9.68 v2(70.58,10.19) ; 367.59,7.01 367.58,7.02 367.58,9.68 v2(368.1,10.19) ; v2(88.55,476.35) 88.24,476.66 88.24,478.03 88.55,478.35 ; v2(62.28,3.71) 62.28,1.43 ; 161.61,469.87 160.75,470.74 160.75,472.98 160.75,472.99 ; 465.88,476.39 465.88,478.68 ; v2(233.05,3.72) 232.74,3.4 232.74,2.03 233.05,1.72 ; v2(469.66,476.36) 469.66,478.64 ; v2(224.44,10.19) 223.93,9.68 223.93,7.02 223.93,7.01 ; v2(234.33,3.72) 234.01,3.4 234.01,2.03 234.33,1.72 ; v2(144.95,3.71) 144.95,1.42 ; v2(140.5,10.18) 139.99,9.67 139.99,7.01 139.99,7.01 ; 398.6,473 398.6,473 398.6,470.76 399.46,469.89 ; 317.09,476.69 317.09,478.03 ; 317.09,476.69 v2(317.41,476.37) ; 317.09,478.03 317.41,478.35 ; 231.53,7.11 231.52,7.11 231.52,9.35 v2(232.39,10.22) ; v2(325.22,10.19) 324.3,9.28 324.3,7.11 324.33,7.08 324.36,7.08 ; v2(401.53,10.22) 400.66,9.35 400.66,7.11 400.66,7.11 ; 221.38,7.01 221.38,7.02 221.38,9.68 v2(221.89,10.19) ; v2(80.24,469.85) 79.38,470.71 79.38,472.96 79.38,472.96 ; 153.15,473.07 153.15,470.41 153.66,469.9 ; v2(241.75,469.85) 240.89,470.71 240.89,472.96 240.89,472.96 ; v2(152.27,10.21) 151.41,9.35 151.41,7.1 151.41,7.1 ; v2(390.82,476.35) 390.82,478.64 ; 147.91,476.38 147.91,478.66 ; v2(75.47,476.35) 75.47,478.64 ; 394.06,469.92 